# Altium schematic sheet FPGA_IOs.SchDoc (continued)
## Nets
GND: C9.1(+) C10.1(+) C34.1(+) C35.1(+) C42.1(+) D2.AH28(IO,_PR_REQUEST,_(DIFFIO_TX_R1n,_DIFFOUT_R1n,_DQ1R)) D2.G5(nCE) D2.Y27(IO,_CLK4n,_FPLL_BR_FBn,_(DIFFIO_RX_R23n,_DIFFOUT_R23n,_DQ3R)) D6.11(GND) D7.4(VSS) DD3.1(GND) DD3.4(~{IN1}) DD3.7(~{IN0}) DD3.17(PAD) R28.1(+) R30.1(+) R32.1(+) R33.1(+) R62.1(+) R138.1(+) R159.2(-)
VCC2P5: C9.2(-) C10.2(-) C34.2(-) D6.2(VCCA) DD3.5(VCC) R35.1(+) R37.1(+) R39.1(+) R45.1(+) R50.2(-) R51.1(+) R52.2(-) R54.2(-) R118.1(+) R119.2(-) R120.2(-) R176.1(+) R177.1(+) R178.2(-) R181.2(-) R183.1(+)
VCC3P3: C35.2(-) C42.2(-) D6.19(VCCB) D7.8(VCC)
CvP_CD: D2.AH29(IO,_CvP_CONFDONE,_(DIFFIO_TX_R3n,_DIFFOUT_R3n,_DQ1R)) R51.2(-)
DBG_LED#0: D2.AG27(IO,_RZQ_1,_(DIFFIO_TX_R1p,_DIFFOUT_R1p,_DQ1R)) HL1.2(K)
DBG_LED#1: D2.AJ29(IO,_nCEO,_(DIFFIO_TX_R3p,_DIFFOUT_R3p,_DQ1R)) HL2.2(K)
DBG_LED#2: D2.AC28(IO,_(DIFFIO_TX_R18p,_DIFFOUT_R18p,_DQ3R)) D2.AE26(IO,_DEV_OE,_(DIFFIO_TX_R5p,_DIFFOUT_R5p)) HL3.2(K)
DBG_LED#3: D2.AC29(IO,_(DIFFIO_TX_R18n,_DIFFOUT_R18n,_DQ3R)) D2.AD7(IO,_CLKUSR,_(DIFFIO_RX_B5p,_DIFFOUT_B5p,_DQ1B)) HL4.2(K)
DEV_CLR: D2.AD27(IO,_DEV_CLRn,_(DIFFIO_TX_R5n,_DIFFOUT_R5n,_DQ1R)) ; port n_FPGA_CLR
EPCQ_CK: D2.U7(DCLK) D6.7(A6)
EPCQ_CK_: D6.14(B6) R191.2(-)
EPCQ_CS#: D2.AB8(nCSO,_DATA4) D6.6(A5)
EPCQ_CS#_: D6.15(B5) D7.1(S#)
EPCQ_D0: D2.AE6(AS_DATA0,_ASDO,_DATA0) D6.1(A1)
EPCQ_D0_: D6.20(B1) D7.5(DQ0)
EPCQ_D1: D2.AE5(AS_DATA1,_DATA1) D6.3(A2)
EPCQ_D1_: D6.18(B2) D7.7(HOLD#/DQ3)
EPCQ_D2: D2.AE8(AS_DATA2,_DATA2) D6.4(A3)
EPCQ_D2_: D6.17(B3) D7.3(W#/DQ2)
EPCQ_D3: D2.AC7(AS_DATA3,_DATA3) D6.5(A4)
EPCQ_D3_: D6.16(B4) D7.2(DQ1)
FPGA_CFG2V5_IO_0: D2.A4(IO,_(DIFFIO_TX_T18p,_DIFFOUT_T18p,_DQ3T,_DQ1T)) ; port CFG_2v5IO_A.FPGA_GPIO2V5_0
FPGA_CFG2V5_IO_1: D2.A3(IO,_(DIFFIO_TX_T18n,_DIFFOUT_T18n,_DQ3T,_DQ1T)) ; port CFG_2v5IO_A.FPGA_GPIO2V5_1
FPGA_CFG2V5_IO_2: D2.D6(IO,_(DIFFIO_TX_T20p,_DIFFOUT_T20p,_DQ3T,_DQ1T)) ; port CFG_2v5IO_A.FPGA_GPIO2V5_2
FPGA_CFG2V5_IO_3: D2.C5(IO,_(DIFFIO_TX_T20n,_DIFFOUT_T20n,_DQ3T,_DQ1T)) ; port CFG_2v5IO_A.FPGA_GPIO2V5_3
FPGA_CFG2V5_IO_4: D2.D5(IO,_(DIFFIO_TX_T22p,_DIFFOUT_T22p)) ; port CFG_2v5IO_A.FPGA_GPIO2V5_4
FPGA_CFG2V5_IO_5: D2.C4(IO,_(DIFFIO_TX_T22n,_DIFFOUT_T22n,_DQ3T,_DQ1T)) ; port CFG_2v5IO_A.FPGA_GPIO2V5_5
FPGA_CFG2V5_IO_6: D2.E8(IO,_(DIFFIO_TX_T24p,_DIFFOUT_T24p,_DQ3T,_DQ1T)) ; port CFG_2v5IO_A.FPGA_GPIO2V5_6
FPGA_CFG2V5_IO_7: D2.D7(IO,_(DIFFIO_TX_T24n,_DIFFOUT_T24n)) ; port CFG_2v5IO_A.FPGA_GPIO2V5_7
FPGA_CFG2V5_IO_8: D2.B2(IO,_(DIFFIO_TX_T26p,_DIFFOUT_T26p,_DQ4T,_DQ2T)) ; port CFG_2v5IO_A.FPGA_GPIO2V5_8
FPGA_CFG2V5_IO_9: D2.B1(IO,_(DIFFIO_TX_T26n,_DIFFOUT_T26n,_DQ4T,_DQ2T)) ; port CFG_2v5IO_A.FPGA_GPIO2V5_9
FPGA_CFG2V5_IO_10: D2.C3(IO,_(DIFFIO_TX_T28p,_DIFFOUT_T28p,_DQ4T,_DQ2T)) ; port CFG_2v5IO_A.FPGA_GPIO2V5_10
FPGA_CFG2V5_IO_11: D2.B3(IO,_(DIFFIO_TX_T28n,_DIFFOUT_T28n,_DQ4T,_DQ2T)) ; port CFG_2v5IO_A.FPGA_GPIO2V5_11
FPGA_CFG2V5_IO_12: D2.D2(IO,_(DIFFIO_TX_T30p,_DIFFOUT_T30p)) ; port CFG_2v5IO_A.FPGA_GPIO2V5_12
FPGA_CFG2V5_IO_13: D2.C2(IO,_(DIFFIO_TX_T30n,_DIFFOUT_T30n,_DQ4T,_DQ2T)) ; port CFG_2v5IO_A.FPGA_GPIO2V5_13
FPGA_CFG2V5_IO_14: D2.E4(IO,_(DIFFIO_TX_T32p,_DIFFOUT_T32p,_DQ4T,_DQ2T)) ; port CFG_2v5IO_A.FPGA_GPIO2V5_14
FPGA_CFG2V5_IO_15: D2.D4(IO,_(DIFFIO_TX_T32n,_DIFFOUT_T32n)) ; port CFG_2v5IO_A.FPGA_GPIO2V5_15
FPGA_CFG2V5_IO_16: D2.E3(IO,_(DIFFIO_TX_T34p,_DIFFOUT_T34p,_DQ5T,_DQ2T)) ; port CFG_2v5IO_A.FPGA_GPIO2V5_16
FPGA_CFG2V5_IO_17: D2.E2(IO,_(DIFFIO_TX_T34n,_DIFFOUT_T34n,_DQ5T,_DQ2T)) ; port CFG_2v5IO_A.FPGA_GPIO2V5_17
FPGA_CFG2V5_IO_18: D2.E1(IO,_(DIFFIO_TX_T36p,_DIFFOUT_T36p,_DQ5T,_DQ2T)) ; port CFG_2v5IO_A.FPGA_GPIO2V5_18
FPGA_CFG2V5_IO_19: D2.D1(IO,_(DIFFIO_TX_T36n,_DIFFOUT_T36n,_DQ5T,_DQ2T)) ; port CFG_2v5IO_A.FPGA_GPIO2V5_19
FPGA_CFG2V5_IO_20: D2.E7(IO,_(DIFFIO_TX_T38p,_DIFFOUT_T38p)) ; port CFG_2v5IO_A.FPGA_GPIO2V5_20
FPGA_CFG2V5_IO_21: D2.E6(IO,_(DIFFIO_TX_T38n,_DIFFOUT_T38n,_DQ5T,_DQ2T)) ; port CFG_2v5IO_A.FPGA_GPIO2V5_21
FPGA_CFG2V5_IO_22: D2.G7(IO,_(DIFFIO_TX_T40p,_DIFFOUT_T40p,_DQ5T,_DQ2T)) ; port CFG_2v5IO_A.FPGA_GPIO2V5_22
FPGA_CFG2V5_IO_23: D2.F6(IO,_(DIFFIO_TX_T40n,_DIFFOUT_T40n)) ; port CFG_2v5IO_A.FPGA_GPIO2V5_23
FPGA_CFG2V5_IO_24: D2.AF29(IO,_(DIFFIO_TX_R14p,_DIFFOUT_R14p)) ; port CFG_2v5IO_B.FPGA_GPIO2V5_0
FPGA_CFG2V5_IO_25: D2.AF30(IO,_(DIFFIO_TX_R14n,_DIFFOUT_R14n,_DQ2R)) ; port CFG_2v5IO_B.FPGA_GPIO2V5_1
FPGA_CFG2V5_IO_26: D2.AA25(IO,_(DIFFIO_TX_R7p,_DIFFOUT_R7p,_DQ1R)) ; port CFG_2v5IO_B.FPGA_GPIO2V5_2
FPGA_CFG2V5_IO_27: D2.AB26(IO,_(DIFFIO_TX_R7n,_DIFFOUT_R7n)) ; port CFG_2v5IO_B.FPGA_GPIO2V5_3
FPGA_CFG2V5_IO_28: D2.AD11(IO,_DATA8,_(DIFFIO_RX_B1p,_DIFFOUT_B1p,_DQ1B))
FPGA_CFG2V5_IO_29: D2.AE12(IO,_DATA6,_(DIFFIO_RX_B1n,_DIFFOUT_B1n,_DQ1B))
FPGA_CFG2V5_IO_30: D2.AC9(IO,_DATA12,_(DIFFIO_RX_B3p,_DIFFOUT_B3p,_DQS1B))
FPGA_CFG2V5_IO_31: D2.AD10(IO,_DATA10,_(DIFFIO_RX_B3n,_DIFFOUT_B3n,_DQSn1B))
FPGA_CFG2V5_IO_32: D2.AG1(IO,_(DIFFIO_RX_B10p,_DIFFOUT_B10p,_DQ2B))
FPGA_CFG2V5_IO_33: D2.AH2(IO,_(DIFFIO_RX_B10n,_DIFFOUT_B10n,_DQ2B))
FPGA_CFG2V5_IO_34: D2.AA12(IO,_(DIFFIO_RX_B11p,_DIFFOUT_B11p,_DQS2B))
FPGA_CFG2V5_IO_35: D2.AB12(IO,_(DIFFIO_RX_B11n,_DIFFOUT_B11n,_DQSn2B))
FPGA_CFG2V5_IO_36: D2.AJ1(IO,_(DIFFIO_RX_B14p,_DIFFOUT_B14p,_DQ2B))
FPGA_CFG2V5_IO_37: D2.AJ2(IO,_(DIFFIO_RX_B14n,_DIFFOUT_B14n,_DQ2B))
FPGA_CFG2V5_IO_38: D2.AD9(IO,_DATA7,_(DIFFIO_TX_B2p,_DIFFOUT_B2p,_DQ1B))
FPGA_CFG2V5_IO_39: D2.AE9(IO,_DATA5,_(DIFFIO_TX_B2n,_DIFFOUT_B2n))
FPGA_CFG2V5_IO_40: D2.AE11(IO,_DATA11,_(DIFFIO_TX_B4p,_DIFFOUT_B4p))
FPGA_CFG2V5_IO_41: D2.AF10(IO,_DATA9,_(DIFFIO_TX_B4n,_DIFFOUT_B4n,_DQ1B))
FPGA_CFG2V5_IO_42: D2.AG3(IO,_DATA15,_(DIFFIO_TX_B6p,_DIFFOUT_B6p,_DQ1B))
FPGA_CFG2V5_IO_43: D2.AH4(IO,_DATA13,_(DIFFIO_TX_B6n,_DIFFOUT_B6n,_DQ1B))
FPGA_CFG2V5_IO_44: D2.AF8(IO,_(DIFFIO_TX_B9p,_DIFFOUT_B9p,_DQ2B))
FPGA_CFG2V5_IO_45: D2.AG7(IO,_(DIFFIO_TX_B9n,_DIFFOUT_B9n))
FPGA_CFG2V5_IO_46: D2.AF6(IO,_(DIFFIO_TX_B12p,_DIFFOUT_B12p))
FPGA_CFG2V5_IO_47: D2.AG6(IO,_(DIFFIO_TX_B12n,_DIFFOUT_B12n,_DQ2B))
GXB_REF_C_CKO_N: C14.1(+) D2.W7(REFCLK0Ln)
GXB_REF_C_CKO_P: C13.1(+) D2.W8(REFCLK0Lp)
GXB_REF_CKI_N: D2.T8(REFCLK1Ln) ; port GXB_CLK_in.GXB_ref_clk_n
GXB_REF_CKI_P: D2.T9(REFCLK1Lp) ; port GXB_CLK_in.GXB_ref_clk_p
GXB_REF_CKO_N: C14.2(-) ; port GXB_CLK_out.GXB_ref_clk_n
GXB_REF_CKO_P: C13.2(-) ; port GXB_CLK_out.GXB_ref_clk_p
GXB_RXA0_N: D2.L1(GXB_RX_L7n,_GXB_REFCLK_L7n) ; port GXB_Rx_bus_x4.GXB_RX_0n
GXB_RXA0_P: D2.L2(GXB_RX_L7p,_GXB_REFCLK_L7p) ; port GXB_Rx_bus_x4.GXB_RX_0p
GXB_RXA1_N: D2.N1(GXB_RX_L6n,_GXB_REFCLK_L6n) ; port GXB_Rx_bus_x4.GXB_RX_1n
GXB_RXA1_P: D2.N2(GXB_RX_L6p,_GXB_REFCLK_L6p) ; port GXB_Rx_bus_x4.GXB_RX_1p
GXB_RXA2_N: D2.R1(GXB_RX_L5n,_GXB_REFCLK_L5n) ; port GXB_Rx_bus_x4.GXB_RX_2n
GXB_RXA2_P: D2.R2(GXB_RX_L5p,_GXB_REFCLK_L5p) ; port GXB_Rx_bus_x4.GXB_RX_2p
GXB_RXA3_N: D2.U1(GXB_RX_L4n,_GXB_REFCLK_L4n) ; port GXB_Rx_bus_x4.GXB_RX_3n
GXB_RXA3_P: D2.U2(GXB_RX_L4p,_GXB_REFCLK_L4p) ; port GXB_Rx_bus_x4.GXB_RX_3p
GXB_TXA0_N: C25.2(-) ; port GXB_Tx_bus_x4.GXB_TX_0n
GXB_TXA0_P: C24.2(-) ; port GXB_Tx_bus_x4.GXB_TX_0p
GXB_TXA1_N: C27.2(-) ; port GXB_Tx_bus_x4.GXB_TX_1n
GXB_TXA1_P: C26.2(-) ; port GXB_Tx_bus_x4.GXB_TX_1p
GXB_TXA2_N: C29.2(-) ; port GXB_Tx_bus_x4.GXB_TX_2n
GXB_TXA2_P: C28.2(-) ; port GXB_Tx_bus_x4.GXB_TX_2p
GXB_TXA3_N: C31.2(-) ; port GXB_Tx_bus_x4.GXB_TX_3n
GXB_TXA3_P: C30.2(-) ; port GXB_Tx_bus_x4.GXB_TX_3p
GXB_TXA_C0_N: C25.1(+) D2.V3(GXB_TX_L3n)
GXB_TXA_C0_P: C24.1(+) D2.V4(GXB_TX_L3p)
GXB_TXA_C1_N: C27.1(+) D2.Y3(GXB_TX_L2n)
GXB_TXA_C1_P: C26.1(+) D2.Y4(GXB_TX_L2p)
GXB_TXA_C2_N: C29.1(+) D2.AB3(GXB_TX_L1n)
GXB_TXA_C2_P: C28.1(+) D2.AB4(GXB_TX_L1p)
GXB_TXA_C3_N: C31.1(+) D2.AD3(GXB_TX_L0n)
GXB_TXA_C3_P: C30.1(+) D2.AD4(GXB_TX_L0p)
INIT_DONE: D2.AD25(IO,_INIT_DONE,_(DIFFIO_RX_R2p,_DIFFOUT_R2p)) R118.2(-)
LVDS0_CKO: D2.AE29(IO,_FPLL_BR_CLKOUT0,_FPLL_BR_CLKOUTp,_FPLL_BR_FB,_(DIFFIO_TX_R22p,_DIFFOUT_R22p)) R43.1(+)
LVDS0_CKO_N: DD3.10(~{OUT0}) ; port LVDS0_TX_x4.LVDS_TX_CK_P
LVDS0_CKO_P: DD3.9(OUT0) ; port LVDS0_TX_x4.LVDS_TX_CK_N
LVDS0_TX0_N: D2.A8(IO,_(DIFFIO_TX_T8n,_DIFFOUT_T8n)) ; port LVDS0_TX_x4.LVDS_TX_0_P
LVDS0_TX0_P: D2.A9(IO,_(DIFFIO_TX_T8p,_DIFFOUT_T8p,_DQ1T)) ; port LVDS0_TX_x4.LVDS_TX_0_N
LVDS0_TX1_N: D2.B8(IO,_(DIFFIO_TX_T12n,_DIFFOUT_T12n,_DQ2T,_DQ1T)) ; port LVDS0_TX_x4.LVDS_TX_1_P
LVDS0_TX1_P: D2.C8(IO,_(DIFFIO_TX_T12p,_DIFFOUT_T12p,_DQ2T,_DQ1T)) ; port LVDS0_TX_x4.LVDS_TX_1_N
LVDS0_TX2_N: D2.B7(IO,_(DIFFIO_TX_T10n,_DIFFOUT_T10n,_DQ2T,_DQ1T)) ; port LVDS0_TX_x4.LVDS_TX_2_P
LVDS0_TX2_P: D2.C7(IO,_(DIFFIO_TX_T10p,_DIFFOUT_T10p,_DQ2T,_DQ1T)) ; port LVDS0_TX_x4.LVDS_TX_2_N
LVDS0_TX3_N: D2.A5(IO,_(DIFFIO_TX_T16n,_DIFFOUT_T16n)) ; port LVDS0_TX_x4.LVDS_TX_3_P
LVDS0_TX3_P: D2.A6(IO,_(DIFFIO_TX_T16p,_DIFFOUT_T16p,_DQ2T,_DQ1T)) ; port LVDS0_TX_x4.LVDS_TX_3_N
LVDS1_CKI_N: D2.AB27(IO,_CLK5n,_(DIFFIO_RX_R21n,_DIFFOUT_R21n,_DQSn3R)) ; port LVDS1_RX_x4.LVDS_RX_CK_P
LVDS1_CKI_P: D2.AA26(IO,_CLK5p,_(DIFFIO_RX_R21p,_DIFFOUT_R21p,_DQS3R)) ; port LVDS1_RX_x4.LVDS_RX_CK_N
LVDS1_CKO: D2.AD29(IO,_FPLL_BR_CLKOUT1,_FPLL_BR_CLKOUTn,_(DIFFIO_TX_R22n,_DIFFOUT_R22n,_DQ3R)) R44.1(+)
LVDS1_CKO_N: DD3.14(~{OUT2}) ; port LVDS1_TX_x4.LVDS_TX_CK_N
LVDS1_CKO_P: DD3.13(OUT2) ; port LVDS1_TX_x4.LVDS_TX_CK_P
LVDS1_RX0_N: D2.AC27(IO,_(DIFFIO_RX_R15n,_DIFFOUT_R15n,_DQ2R)) ; port LVDS1_RX_x4.LVDS_RX_0_P
LVDS1_RX0_P: D2.AD26(IO,_(DIFFIO_RX_R15p,_DIFFOUT_R15p,_DQ2R)) ; port LVDS1_RX_x4.LVDS_RX_0_N
LVDS1_RX1_N: D2.Y21(IO,_(DIFFIO_RX_R4n,_DIFFOUT_R4n,_DQ1R)) ; port LVDS1_RX_x4.LVDS_RX_1_P
LVDS1_RX1_P: D2.W20(IO,_(DIFFIO_RX_R4p,_DIFFOUT_R4p,_DQ1R)) ; port LVDS1_RX_x4.LVDS_RX_1_N
LVDS1_RX2_N: D2.AB23(IO,_(DIFFIO_RX_R8n,_DIFFOUT_R8n,_DQ1R)) ; port LVDS1_RX_x4.LVDS_RX_2_P
LVDS1_RX2_P: D2.AB22(IO,_(DIFFIO_RX_R8p,_DIFFOUT_R8p,_DQ1R)) ; port LVDS1_RX_x4.LVDS_RX_2_N
LVDS1_RX3_N: D2.AB25(IO,_(DIFFIO_RX_R9n,_DIFFOUT_R9n)) ; port LVDS1_RX_x4.LVDS_RX_3_P
LVDS1_RX3_P: D2.AA24(IO,_(DIFFIO_RX_R9p,_DIFFOUT_R9p)) ; port LVDS1_RX_x4.LVDS_RX_3_N
LVDS1_TX0_N: D2.AA28(IO,_(DIFFIO_TX_R20n,_DIFFOUT_R20n,_DQ3R)) ; port LVDS1_TX_x4.LVDS_TX_0_N
LVDS1_TX0_P: D2.AB28(IO,_(DIFFIO_TX_R20p,_DIFFOUT_R20p,_DQ3R)) ; port LVDS1_TX_x4.LVDS_TX_0_P
LVDS1_TX1_N: D2.AC30(IO,_RZQ_2,_(DIFFIO_TX_R24n,_DIFFOUT_R24n)) ; port LVDS1_TX_x4.LVDS_TX_1_N
LVDS1_TX1_P: D2.AD30(IO,_(DIFFIO_TX_R24p,_DIFFOUT_R24p,_DQ3R)) ; port LVDS1_TX_x4.LVDS_TX_1_P
LVDS1_TX2_N: D2.AF28(IO,_(DIFFIO_TX_R12n,_DIFFOUT_R12n,_DQ2R)) ; port LVDS1_TX_x4.LVDS_TX_2_N
LVDS1_TX2_P: D2.AG28(IO,_(DIFFIO_TX_R12p,_DIFFOUT_R12p,_DQ2R)) ; port LVDS1_TX_x4.LVDS_TX_2_P
LVDS1_TX3_N: D2.AG30(IO,_(DIFFIO_TX_R16n,_DIFFOUT_R16n)) ; port LVDS1_TX_x4.LVDS_TX_3_N
LVDS1_TX3_P: D2.AH30(IO,_(DIFFIO_TX_R16p,_DIFFOUT_R16p,_DQ2R)) ; port LVDS1_TX_x4.LVDS_TX_3_P
MIPI_CSI-2_A_CK24_2v5: D2.A11(IO,_FPLL_TL_CLKOUT0,_FPLL_TL_CLKOUTp,_FPLL_TL_FB,_(DIFFIO_TX_T4p,_DIFFOUT_T4p,_DQ1T)) ; port MIPI_CLK24_2v5.A
MIPI_CSI-2_A_I2C_CL_2v5: D2.B11(IO,_(DIFFIO_TX_T6n,_DIFFOUT_T6n,_DQ1T)) ; port MIPI_I2C.A_CL
MIPI_CSI-2_A_I2C_DA_2v5: D2.C12(IO,_(DIFFIO_TX_T6p,_DIFFOUT_T6p)) ; port MIPI_I2C.A_DA
MIPI_CSI-2_B_CK24_2v5: D2.A10(IO,_FPLL_TL_CLKOUT1,_FPLL_TL_CLKOUTn,_(DIFFIO_TX_T4n,_DIFFOUT_T4n,_DQ1T)) ; port MIPI_CLK24_2v5.B
MIPI_CSI-2_B_I2C_CL_2v5: D2.C9(IO,_(DIFFIO_TX_T14n,_DIFFOUT_T14n,_DQ2T,_DQ1T)) ; port MIPI_I2C.B_CL
MIPI_CSI-2_B_I2C_DA_2v5: D2.C10(IO,_(DIFFIO_TX_T14p,_DIFFOUT_T14p)) ; port MIPI_I2C.B_DA
MIPI_CSI_CKA_HS_N: D2.G15(IO,_CLK7n,_(DIFFIO_RX_T1n,_DIFFOUT_T1n)) ; port MIPI_CSI-2_A_HS.MIPI_CSI_CK_N
MIPI_CSI_CKA_HS_P: D2.H15(IO,_CLK7p,_(DIFFIO_RX_T1p,_DIFFOUT_T1p)) ; port MIPI_CSI-2_A_HS.MIPI_CSI_CK_P
MIPI_CSI_CKA_LP_N: D2.G13(IO,_(DIFFIO_RX_T13n,_DIFFOUT_T13n,_DQSn2T,_DQSn1T)) ; port MIPI_CSI-2_A_LP.MIPI_CSI_CK_N
MIPI_CSI_CKA_LP_P: D2.H14(IO,_(DIFFIO_RX_T13p,_DIFFOUT_T13p,_DQS2T,_DQS1T)) ; port MIPI_CSI-2_A_LP.MIPI_CSI_CK_P
MIPI_CSI_CKB_HS_N: D2.J14(IO,_CLK6n,_FPLL_TL_FBn,_(DIFFIO_RX_T9n,_DIFFOUT_T9n)) ; port MIPI_CSI-2_B_HS.MIPI_CSI_CK_N
MIPI_CSI_CKB_HS_P: D2.K14(IO,_CLK6p,_FPLL_TL_FBp,_(DIFFIO_RX_T9p,_DIFFOUT_T9p)) ; port MIPI_CSI-2_B_HS.MIPI_CSI_CK_P
MIPI_CSI_CKB_LP_N: D2.B5(IO,_(DIFFIO_RX_T27n,_DIFFOUT_T27n,_DQ4T,_DQ2T)) ; port MIPI_CSI-2_B_LP.MIPI_CSI_CK_N
MIPI_CSI_CKB_LP_P: D2.B6(IO,_(DIFFIO_RX_T27p,_DIFFOUT_T27p,_DQ4T,_DQ2T)) ; port MIPI_CSI-2_B_LP.MIPI_CSI_CK_P
MIPI_CSI_DA0_HS_N: D2.F14(IO,_(DIFFIO_RX_T5n,_DIFFOUT_T5n,_DQSn1T)) ; port MIPI_CSI-2_A_HS.MIPI_CSI_D0_N
MIPI_CSI_DA0_HS_P: D2.F15(IO,_(DIFFIO_RX_T5p,_DIFFOUT_T5p,_DQS1T)) ; port MIPI_CSI-2_A_HS.MIPI_CSI_D0_P
MIPI_CSI_DA0_LP_N: D2.G11(IO,_(DIFFIO_RX_T31n,_DIFFOUT_T31n,_DQ4T,_DQ2T)) ; port MIPI_CSI-2_A_LP.MIPI_CSI_D0_N
MIPI_CSI_DA0_LP_P: D2.G12(IO,_(DIFFIO_RX_T31p,_DIFFOUT_T31p,_DQ4T,_DQ2T)) ; port MIPI_CSI-2_A_LP.MIPI_CSI_D0_P
MIPI_CSI_DA1_HS_N: D2.E13(IO,_(DIFFIO_RX_T15n,_DIFFOUT_T15n,_DQ2T,_DQ1T)) ; port MIPI_CSI-2_A_HS.MIPI_CSI_D1_N
MIPI_CSI_DA1_HS_P: D2.F13(IO,_(DIFFIO_RX_T15p,_DIFFOUT_T15p,_DQ2T,_DQ1T)) ; port MIPI_CSI-2_A_HS.MIPI_CSI_D1_P
MIPI_CSI_DA1_LP_N: D2.F10(IO,_(DIFFIO_RX_T35n,_DIFFOUT_T35n,_DQ5T,_DQ2T)) ; port MIPI_CSI-2_A_LP.MIPI_CSI_D1_N
MIPI_CSI_DA1_LP_P: D2.G10(IO,_(DIFFIO_RX_T35p,_DIFFOUT_T35p,_DQ5T,_DQ2T)) ; port MIPI_CSI-2_A_LP.MIPI_CSI_D1_P
MIPI_CSI_DA2_HS_N: D2.D12(IO,_(DIFFIO_RX_T19n,_DIFFOUT_T19n,_DQ3T,_DQ1T)) ; port MIPI_CSI-2_A_HS.MIPI_CSI_D2_N
MIPI_CSI_DA2_HS_P: D2.E12(IO,_(DIFFIO_RX_T19p,_DIFFOUT_T19p,_DQ3T,_DQ1T)) ; port MIPI_CSI-2_A_HS.MIPI_CSI_D2_P
MIPI_CSI_DA2_LP_N: D2.E11(IO,_(DIFFIO_RX_T23n,_DIFFOUT_T23n,_DQ3T,_DQ1T)) ; port MIPI_CSI-2_A_LP.MIPI_CSI_D2_N
MIPI_CSI_DA2_LP_P: D2.F11(IO,_(DIFFIO_RX_T23p,_DIFFOUT_T23p,_DQ3T,_DQ1T)) ; port MIPI_CSI-2_A_LP.MIPI_CSI_D2_P
MIPI_CSI_DA3_HS_N: D2.B12(IO,_(DIFFIO_RX_T3n,_DIFFOUT_T3n,_DQ1T)) ; port MIPI_CSI-2_A_HS.MIPI_CSI_D3_N
MIPI_CSI_DA3_HS_P: D2.C13(IO,_(DIFFIO_RX_T3p,_DIFFOUT_T3p,_DQ1T)) ; port MIPI_CSI-2_A_HS.MIPI_CSI_D3_P
MIPI_CSI_DA3_LP_N: D2.D10(IO,_(DIFFIO_RX_T7n,_DIFFOUT_T7n,_DQ1T)) ; port MIPI_CSI-2_A_LP.MIPI_CSI_D3_N
MIPI_CSI_DA3_LP_P: D2.D11(IO,_(DIFFIO_RX_T7p,_DIFFOUT_T7p,_DQ1T)) ; port MIPI_CSI-2_A_LP.MIPI_CSI_D3_P
MIPI_CSI_DB0_HS_N: D2.K8(IO,_(DIFFIO_RX_T33n,_DIFFOUT_T33n)) ; port MIPI_CSI-2_B_HS.MIPI_CSI_D0_N
MIPI_CSI_DB0_HS_P: D2.K7(IO,_(DIFFIO_RX_T33p,_DIFFOUT_T33p)) ; port MIPI_CSI-2_B_HS.MIPI_CSI_D0_P
MIPI_CSI_DB0_LP_N: D2.H7(IO,_(DIFFIO_RX_T25n,_DIFFOUT_T25n)) ; port MIPI_CSI-2_B_LP.MIPI_CSI_D0_N
MIPI_CSI_DB0_LP_P: D2.J7(IO,_(DIFFIO_RX_T25p,_DIFFOUT_T25p)) ; port MIPI_CSI-2_B_LP.MIPI_CSI_D0_P
MIPI_CSI_DB1_HS_N: D2.J9(IO,_(DIFFIO_RX_T37n,_DIFFOUT_T37n,_DQSn5T,_DQ2T)) ; port MIPI_CSI-2_B_HS.MIPI_CSI_D1_N
MIPI_CSI_DB1_HS_P: D2.J10(IO,_(DIFFIO_RX_T37p,_DIFFOUT_T37p,_DQS5T,_DQ2T)) ; port MIPI_CSI-2_B_HS.MIPI_CSI_D1_P
MIPI_CSI_DB1_LP_N: D2.G8(IO,_(DIFFIO_RX_T17n,_DIFFOUT_T17n)) ; port MIPI_CSI-2_B_LP.MIPI_CSI_D1_N
MIPI_CSI_DB1_LP_P: D2.H8(IO,_(DIFFIO_RX_T17p,_DIFFOUT_T17p)) ; port MIPI_CSI-2_B_LP.MIPI_CSI_D1_P
MIPI_CSI_DB2_HS_N: D2.J12(IO,_(DIFFIO_RX_T29n,_DIFFOUT_T29n,_DQSn4T,_DQSn2T)) ; port MIPI_CSI-2_B_HS.MIPI_CSI_D2_N
MIPI_CSI_DB2_HS_P: D2.K12(IO,_(DIFFIO_RX_T29p,_DIFFOUT_T29p,_DQS4T,_DQS2T)) ; port MIPI_CSI-2_B_HS.MIPI_CSI_D2_P
MIPI_CSI_DB2_LP_N: D2.F8(IO,_(DIFFIO_RX_T39n,_DIFFOUT_T39n,_DQ5T,_DQ2T)) ; port MIPI_CSI-2_B_LP.MIPI_CSI_D2_N
MIPI_CSI_DB2_LP_P: D2.F9(IO,_(DIFFIO_RX_T39p,_DIFFOUT_T39p,_DQ5T,_DQ2T)) ; port MIPI_CSI-2_B_LP.MIPI_CSI_D2_P
MIPI_CSI_DB3_HS_N: D2.H12(IO,_(DIFFIO_RX_T21n,_DIFFOUT_T21n,_DQSn3T,_DQ1T)) ; port MIPI_CSI-2_B_HS.MIPI_CSI_D3_N
MIPI_CSI_DB3_HS_P: D2.H13(IO,_(DIFFIO_RX_T21p,_DIFFOUT_T21p,_DQS3T,_DQ1T)) ; port MIPI_CSI-2_B_HS.MIPI_CSI_D3_P
MIPI_CSI_DB3_LP_N: D2.D9(IO,_(DIFFIO_RX_T11n,_DIFFOUT_T11n,_DQ2T,_DQ1T)) ; port MIPI_CSI-2_B_LP.MIPI_CSI_D3_N
MIPI_CSI_DB3_LP_P: D2.E9(IO,_(DIFFIO_RX_T11p,_DIFFOUT_T11p,_DQ2T,_DQ1T)) ; port MIPI_CSI-2_B_LP.MIPI_CSI_D3_P
MSEL0: D2.L8(MSEL0) ; port FPGA_MSEL.FPGA_MSEL0
MSEL1: D2.K6(MSEL1) ; port FPGA_MSEL.FPGA_MSEL1
MSEL2: D2.G6(MSEL2) ; port FPGA_MSEL.FPGA_MSEL2
MSEL3: D2.L7(MSEL3) ; port FPGA_MSEL.FPGA_MSEL3
MSEL4: D2.L9(MSEL4) ; port FPGA_MSEL.FPGA_MSEL4
n_FPGA_RST_O: D2.AE27(IO,_(DIFFIO_TX_R10p,_DIFFOUT_R10p,_DQ2R)) ; port n_FPGA_RST_O
n_PERST0: D6.13(B7) ; port n_PERST0
n_PERST0_2v5: D2.W21(IO,_nPERSTL0,_(DIFFIO_RX_R6p,_DIFFOUT_R6p,_DQS1R)) D6.8(A7)
n_PERST1: D6.12(B8) ; port n_PERST1
n_PERST1_2v5: D2.W22(IO,_nPERSTL1,_(DIFFIO_RX_R6n,_DIFFOUT_R6n,_DQSn1R)) D6.9(A8)
OSC_50_B5A5B: D2.Y26(IO,_CLK4p,_FPLL_BR_FBp,_(DIFFIO_RX_R23p,_DIFFOUT_R23p,_DQ3R)) ; port OSC_50_3
PR_DONE: D2.AF5(IO,_PR_DONE,_(DIFFIO_RX_B7n,_DIFFOUT_B7n)) R37.2(-)
PR_ERR: D2.AF4(IO,_PR_ERROR,_(DIFFIO_RX_B7p,_DIFFOUT_B7p)) R35.2(-)
PR_RDY: D2.AG8(IO,_PR_READY,_(DIFFIO_TX_B8n,_DIFFOUT_B8n,_DQ1B)) R39.2(-)
TCK: D2.AC5(TCK) ; port FPGA_JTAG.FPGA_JTAG_TCK
TDI: D2.U8(TDI) R177.2(-) ; port FPGA_JTAG.FPGA_JTAG_TDI
TDO: D2.AB9(TDO) ; port FPGA_JTAG.FPGA_JTAG_TDO
TMS: D2.V9(TMS) R176.2(-) ; port FPGA_JTAG.FPGA_JTAG_TMS
NetD2_AA1: D2.AA1(GXB_RX_L2n,_GXB_REFCLK_L2n) D2.AA2(GXB_RX_L2p,_GXB_REFCLK_L2p) R138.2(-)
NetD2_AC1: D2.AC1(GXB_RX_L1n,_GXB_REFCLK_L1n) D2.AC2(GXB_RX_L1p,_GXB_REFCLK_L1p) R28.2(-)
NetD2_AE1: D2.AE1(GXB_RX_L0n,_GXB_REFCLK_L0n) D2.AE2(GXB_RX_L0p,_GXB_REFCLK_L0p) R62.2(-)
NetD2_F3: D2.F3(CONF_DONE) R178.1(+)
NetD2_F4: D2.F4(nSTATUS) R120.1(+)
NetD2_G1: D2.G1(RREF_TL) R159.1(+)
NetD2_J1: D2.J1(GXB_RX_L8n,_GXB_REFCLK_L8n) D2.J2(GXB_RX_L8p,_GXB_REFCLK_L8p) R33.2(-)
NetD2_J5: D2.J5(nCONFIG) R181.1(+)
NetD2_P8: D2.P8(REFCLK2Ln) D2.P9(REFCLK2Lp) R32.2(-)
NetD2_W1: D2.W1(GXB_RX_L3n,_GXB_REFCLK_L3n) D2.W2(GXB_RX_L3p,_GXB_REFCLK_L3p) R30.2(-)
NetD6_10: D6.10(OE) R183.2(-)
NetD7_6: D7.6(C) R191.1(+)
NetDD3_2: DD3.2(EN) R45.2(-)
NetDD3_3: DD3.3(IN1) R44.2(-)
NetDD3_6: DD3.6(IN0) R43.2(-)
NetHL1_1: HL1.1(A) R50.1(+)
NetHL2_1: HL2.1(A) R52.1(+)
NetHL3_1: HL3.1(A) R54.1(+)
NetHL4_1: HL4.1(A) R119.1(+)

Not connected (* = marked no-connect by the designer): D2 A13(IO,_(DIFFIO_TX_T2n,_DIFFOUT_T2n,_DQ1T))* AA7(DNU) AA30(IO,_(DIFFIO_RX_R19n,_DIFFOUT_R19n,_DQ3R))* AB30(IO,_(DIFFIO_RX_R19p,_DIFFOUT_R19p,_DQ3R))* AC12(IO,_(DIFFIO_RX_B15p,_DIFFOUT_B15p))* AC25(IO,_CRC_ERROR,_(DIFFIO_RX_R2n,_DIFFOUT_R2n))* AD12(IO,_(DIFFIO_RX_B15n,_DIFFOUT_B15n))* AD15(DNU) AE7(IO,_DATA14,_(DIFFIO_RX_B5n,_DIFFOUT_B5n,_DQ1B))* AE28(IO,_(DIFFIO_TX_R10n,_DIFFOUT_R10n,_DQ2R))* AF9(IO,_(DIFFIO_TX_B8p,_DIFFOUT_B8p,_DQ1B))* AG2(IO,_(DIFFIO_TX_B16p,_DIFFOUT_B16p,_DQ2B))* AG5(IO,_(DIFFIO_TX_B13p,_DIFFOUT_B13p,_DQ2B))* AH3(IO,_(DIFFIO_TX_B16n,_DIFFOUT_B16n,_DQ2B))* AH5(IO,_(DIFFIO_TX_B13n,_DIFFOUT_B13n,_DQ2B))* B13(IO,_(DIFFIO_TX_T2p,_DIFFOUT_T2p,_DQ1T))* E26(DNU) F1(DNU) G2(DNU) H3(GXB_TX_L8n)* H4(GXB_TX_L8p)* J15(DNU) K3(GXB_TX_L7n)* K4(GXB_TX_L7p)* M3(GXB_TX_L6n)* M4(GXB_TX_L6p)* P3(GXB_TX_L5n)* P4(GXB_TX_L5p)* T3(GXB_TX_L4n)* T4(GXB_TX_L4p)* V23(IO,_(DIFFIO_RX_R13p,_DIFFOUT_R13p,_DQS2R))* V25(IO,_(DIFFIO_RX_R17n,_DIFFOUT_R17n))* W24(IO,_(DIFFIO_RX_R13n,_DIFFOUT_R13n,_DQSn2R))* W25(IO,_(DIFFIO_RX_R17p,_DIFFOUT_R17p))* Y23(IO,_(DIFFIO_RX_R11p,_DIFFOUT_R11p,_DQ2R))* Y24(IO,_(DIFFIO_RX_R11n,_DIFFOUT_R11n,_DQ2R))*; DD3 8(V_acr)* 11(OUT1)* 12(~{OUT1})* 15(OUT3)* 16(~{OUT3})*

## Layout directives
differential pair: GXB_REF_C_CKO_N, GXB_REF_C_CKO_P, GXB_REF_CKI_N, GXB_REF_CKI_P, GXB_REF_CKO_N, GXB_REF_CKO_P, GXB_RXA0_N, GXB_RXA0_P, GXB_RXA1_N, GXB_RXA1_P, GXB_RXA2_N, GXB_RXA2_P, GXB_RXA3_N, GXB_RXA3_P, GXB_TXA0_N, GXB_TXA0_P, GXB_TXA1_N, GXB_TXA1_P, GXB_TXA2_N, GXB_TXA2_P, GXB_TXA3_N, GXB_TXA3_P, GXB_TXA_C0_N, GXB_TXA_C0_P, GXB_TXA_C1_N, GXB_TXA_C1_P, GXB_TXA_C2_N, GXB_TXA_C2_P, GXB_TXA_C3_N, GXB_TXA_C3_P, LVDS0_CKO_N, LVDS0_CKO_P, LVDS0_TX0_N, LVDS0_TX0_P, LVDS0_TX1_N, LVDS0_TX1_P, LVDS0_TX2_N, LVDS0_TX2_P, LVDS0_TX3_N, LVDS0_TX3_P, LVDS1_CKI_N, LVDS1_CKI_P, LVDS1_CKO_N, LVDS1_CKO_P, LVDS1_RX0_N, LVDS1_RX0_P, LVDS1_RX1_N, LVDS1_RX1_P, LVDS1_RX2_N, LVDS1_RX2_P, LVDS1_RX3_N, LVDS1_RX3_P, LVDS1_TX0_N, LVDS1_TX0_P, LVDS1_TX1_N, LVDS1_TX1_P, LVDS1_TX2_N, LVDS1_TX2_P, LVDS1_TX3_N, LVDS1_TX3_P, MIPI_CSI_CKA_HS_N, MIPI_CSI_CKA_HS_P, MIPI_CSI_CKB_HS_N, MIPI_CSI_CKB_HS_P, MIPI_CSI_DA0_HS_N, MIPI_CSI_DA0_HS_P, MIPI_CSI_DA1_HS_N, MIPI_CSI_DA1_HS_P, MIPI_CSI_DA2_HS_N, MIPI_CSI_DA2_HS_P, MIPI_CSI_DA3_HS_N, MIPI_CSI_DA3_HS_P, MIPI_CSI_DB0_HS_N, MIPI_CSI_DB0_HS_P, MIPI_CSI_DB1_HS_N, MIPI_CSI_DB1_HS_P, MIPI_CSI_DB2_HS_N, MIPI_CSI_DB2_HS_P, MIPI_CSI_DB3_HS_N, MIPI_CSI_DB3_HS_P

## Notes on the sheet
- (near D2) Form connector B
- (near D2) OD
- OD_IO
- (near D2) VCCIO=2.5V
- (near D2) VCCIO=2.5
- Form connector C
- To connector C
- (near D2) VCCPGM=2.5V
- (in symbol 5CSXFC6D6F31I7N, part A) BANK 3A
- (in symbol 5CSXFC6D6F31I7N, part D) BANK 5A
- (in symbol 5CSXFC6D6F31I7N, part E) BANK 5B
- (in symbol 5CSXFC6D6F31I7N, part L) BANK 8A
- (in symbol 5CSXFC6D6F31I7N, part R) BANK 3A; BANK 9A
- (in symbol CR0402-#-±1%) 0402
- (in symbol CR0402-#-±5%) 0402

## Library data of the parts
C9 C10 C13 C14 C24-C31 C34 C35 C42 = CC0402-X7R-#-20%-10В: Чип конденсатор керамический; Supplier 1: Digi-Key
  C9 C13 C14 C24-C31 C34 C35 C42: Supplier Part Number 1: 399-3520-1-ND
  C10: Supplier Part Number 1: 490-13211-6-ND
D2 = 5CSXFC6D6F31I7N: Cyclone V SX Family FPGA, 1.07 to 1.13 V Supply, 288 I/O Pins, 6 PLLs, 896-Pin FBGA, Speed Grade 7, Industrial Grade, RoHS Compliant; Manufacturer: Altera; Logic Elements (LE) (K): 110; Speed Grade: 7; DatasheetVersion: Rev. 3.4; PackageVersion: Rev. 2.0, 12/2012; PackageReference: FBGA896_A-200; PackageDescription: 896-Pin FineLine Ball-Grid Array (FBGA), Body 31 x 31 mm, Pitch 1 mm; Supplier 1: Digi-Key; Supplier Part Number 1: 5CSXFC6D6F31I7N-ND; Supplier 2: Mouser; Supplier Part Number 2: 989-5CSXFC6D6F31I7N; Device Group: 5CSXFC6; RoHS: RoHS Compliant; Subcategory: Cyclone V SX; Voltage Supply: 1.07 to 1.13 V; NexusDeviceID: 5CSXFC6D6F31I7N; Mounting Technology: Surface Mount; Code_JEDEC: MS-034; PartNumber: 5CSXFC6D6F31I7N; ComponentLink1Description: Manufacturer URL; ComponentLink1URL: http://www.altera.com; ComponentLink2Description: Datasheet; ComponentLink2URL: http://www.altera.com/literature/hb/cyclone-v/cv_51002.pdf; ComponentLink3Description: Package Specification; ComponentLink3URL: http://www.altera.com/devicepackaging/04R00435-01.pdf; ComponentLink4Description: Device Handbook URL; ComponentLink4URL: http://www.altera.com/literature/hb/cyclone-v/cyclone5_handbook.pdf; ComponentLink5Description: Device Pin-Out URL; ComponentLink5URL: http://www.altera.com/literature/dp/cyclone-v/5CSXFC6.xls; ComponentLink6Description: Product URL; ComponentLink6URL: http://www.buyaltera.com/scripts/partsearch.dll?Detail&name=5CSXFC6D6F31I7N-ND
D6 = TXS0108ERGYR: 8-Bit Bidirectional Voltage-Level Translator with Auto Direction Sensing and +/-15-kV ESD Protect, VQFN-20 LARGE T&R; Generic Part Number: TXB0108; Manufacturer: Texas Instruments; VCC(Min)(V): 1.2; VCC(Max)(V): 5.5; Output Type: CMOS; Logic: True; ICC @ Nom Voltage(Max)(mA): 0.005; Input Type: CMOS/TTL; Bits(#): 8; Rating: Catalog; Voltage(Nom)(V): 3.3; Schmitt Trigger: No; Sub-Family: Dual Supply Translator; tpd @ Nom Voltage(Max)(ns): 4.9; PackageReference: VQFN-20; Supplier 1: Mouser; Supplier Part Number 1: 595-TXS0108ERGYR; Supplier 2: Digi-Key; Supplier Part Number 2: 296-24806-2-ND; Supplier 3: Digi-Key; Supplier Part Number 3: 296-24806-1-ND; Supplier 4: Digi-Key; Supplier Part Number 4: 296-24806-6-ND; Operating Temperature Range(C): -40 to 85; 3-State Output: No; PartNumber: TXS0108ERGYR; ComponentLink1Description: Manufacturer URL; ComponentLink1URL: http://www.ti.com/; ComponentLink2Description: Datasheet; ComponentLink2URL: http://www.ti.com/lit/ds/symlink/txs0108e.pdf
D7 = MT25QL512ABB1EW9-0SIT: 512 Mb (x1/x2/x4) Serial NOR Flash Memory with Multi I/O, 108 MHz, 2.7 to 3.6 V, 16-pin SO16 Wide (SF), Tape & Reel; Part Family: MT25Q; Manufacturer: Micron; Density: 512Mb; Speed: 133 MHz; Voltage: 2.7V-3.6V; DatasheetVersion: Rev. J; PackageReference: 8-WDFN; PackageDescription: 8-WPDFN (6x8) (MLP8); Applications: Embedded; Package: 8-WDFN Exposed Pad; Part Status: Production; RoHS: Yes; Type: Multi I/O; Width: x1/x2/x4; Mounting Technology: Surface Mount; PartNumber: MT25QL512ABB1EW9-0SIT; ComponentLink1Description: Manufacturer URL; ComponentLink1URL: http://www.micron.com/; ComponentLink2Description: Datasheet; ComponentLink2URL: https://www.micron.com/~/media/documents/products/data-sheet/nor-flash/serial-nor/mt25q/die-rev-b/mt25q_qlkt_l_512_abb_0.pdf; ComponentLink3Description: Package Specification; ComponentLink3URL: https://www.micron.com/~/media/documents/products/data-sheet/nor-flash/serial-nor/mt25q/die-rev-b/mt25q_qlkt_l_512_abb_0.pdf
DD3 = CDCLVD2102RGTT: Dual 1:2 Low Additive Jitter LVDS Buffer; Supplier 1: Digi-Key; Supplier Part Number 1: 296-27612-2-ND
HL1 = KPT-1608SURC: Светодиод красный SMD0603; Supplier 1: Newark; Supplier Part Number 1: 93T1595
HL2 = KPT-1608SYC: Светодиод желтый SMD0603; Supplier 1: Farnell; Supplier Part Number 1: 2335795
HL3 HL4 = KPT-1608ZGC: Светодиод зеленый SMD0603; Supplier 1: Farnell; Supplier Part Number 1: 2373504
R28 R30 R32 R33 R62 R138 = CR0402-#-±5%: Чип резистор; Maximum Working Voltage: 50 В; TOLERANCE: 5%; VALUE: 0 Ом; Supplier 1: Digi-Key; Supplier Part Number 1: 311-10.0KLRDKR-ND
R35 R37 R39 R43-R45 R50-R52 R54 R118-R120 R176-R178 R181 R183 R191 = CR0402-#-±5%: Чип резистор; Maximum Working Voltage: 50 В; TOLERANCE: 5%; Supplier 1: Digi-Key
  R35 R37 R39 R51 R118 R120 R178 R181 R183: Supplier Part Number 1: 311-10.0KJRTR-ND
  R43 R44 R191: Supplier Part Number 1: 311-10.0KLRDKR-ND
  R45 R176 R177: Supplier Part Number 1: 311-4.7KJRTR-ND
  R50 R52 R54 R119: Supplier Part Number 1: 311-240JRTR-ND
R159 = CR0402-#-±1%: Чип резистор; Maximum Working Voltage: 50 В; Supplier 1: Digi-Key; Supplier Part Number 1: 311-2KLRCT-ND